# EasyEDA Pro project remote-a-v101.eprj, board main-board (continued)
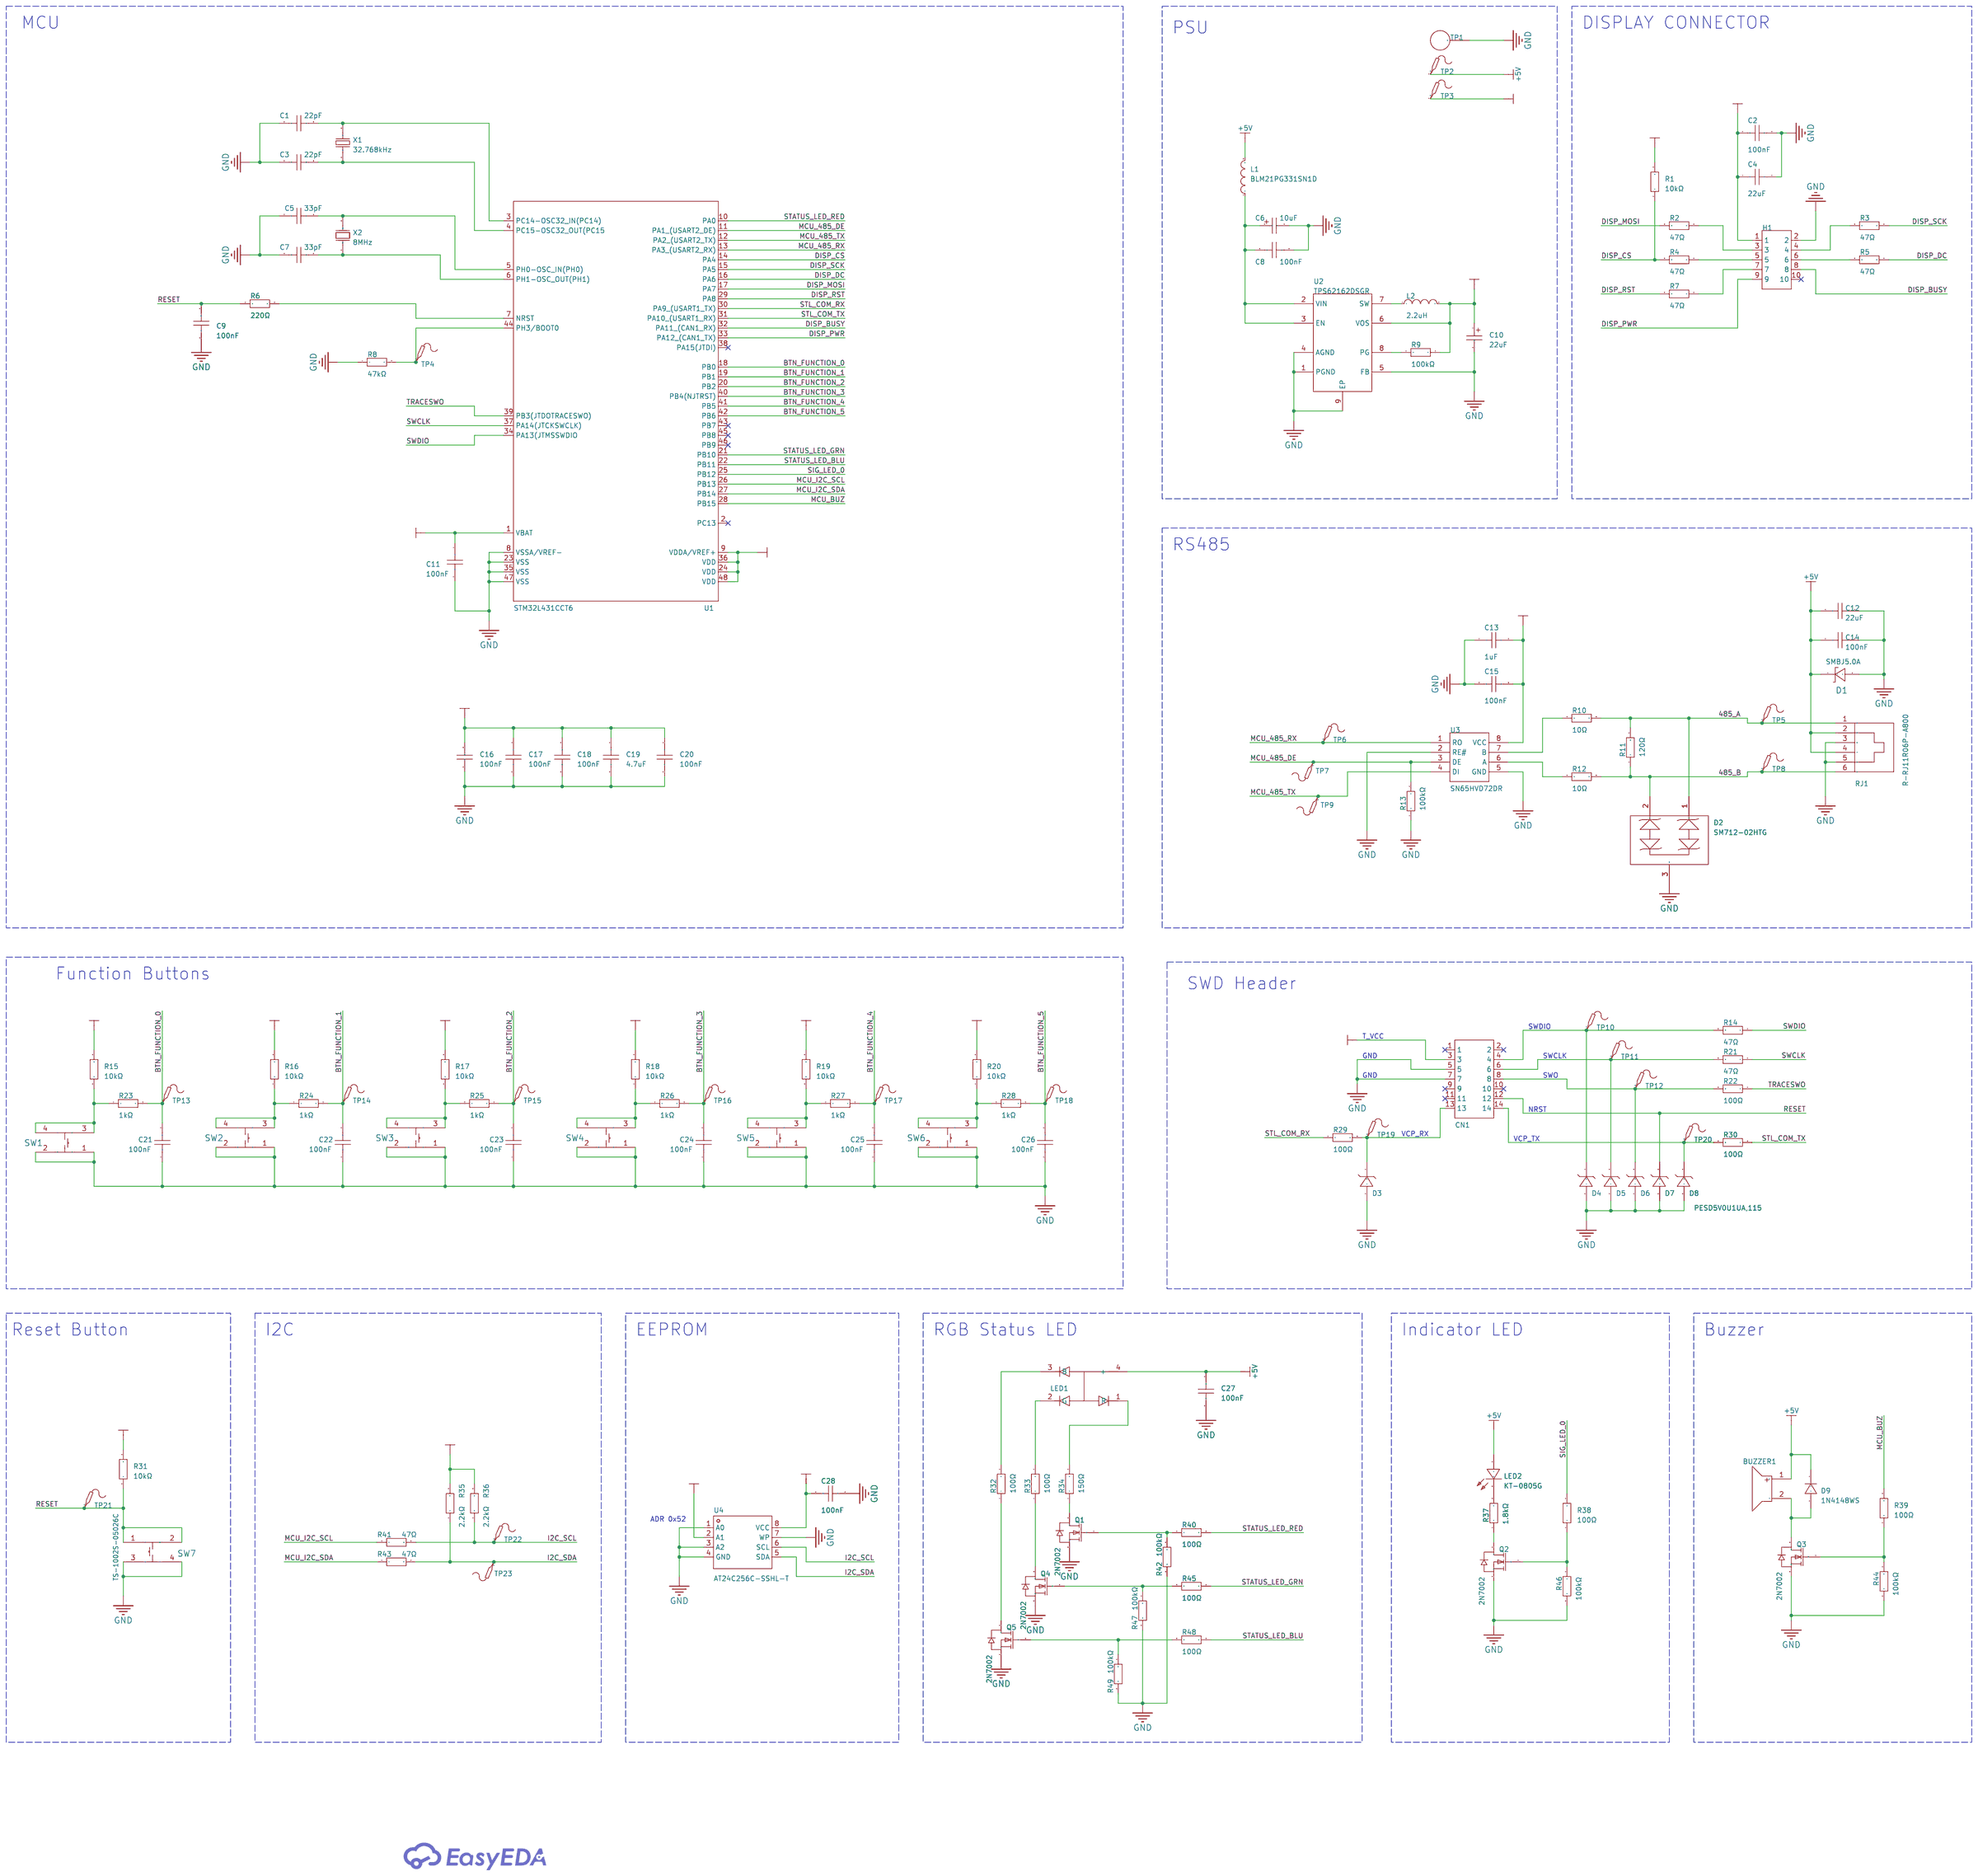
[diagram p0: schematic sheet]
## Footprints (pads in the part's own frame, mm; a bottom-side part is the same pattern mirrored in y, then rotated)
BUZ-TH_BD12.0-P6.50-D0.8
  round 1.8 hole 1.2: 1(-3.3,0) 2(3.3,0)
C0603
  rect 0.8x0.9 smd: 1(-0.7,0) 2(0.7,0)
C0805
  rect 1.41x1.35 smd: 1(-1,0) 2(1,0)
C1206
  rect 1.485x1.728 smd: 1(-1.593,0) 2(1.593,0)
CRYSTAL-SMD_L5.0-W3.2
  rect 1.9x2.4 smd: 1(-2.05,0) 2(2.05,0)
FC-135R_L3.2-W1.5
  rect 1x1.8 smd: 1(-1.25,0) 2(1.25,0)
HDR-TH_10P-P2.54-V-M-R2-C5-S2.54
  rect 1.7x1.7 hole 1.1: 1(-5.08,-1.27)
  round 1.7 hole 1.1: 2(-5.08,1.27) 3(-2.54,-1.27) 4(-2.54,1.27) 5(0,-1.27) 6(0,1.27) 7(2.54,-1.27) 8(2.54,1.27) 9(5.08,-1.27) 10(5.08,1.27)
HDR-TH_14P-P1.27-V-M-R2-C7-S1.27-2
  rect 1x1 hole 0.7: 1(-3.81,-0.635)
  round 1 hole 0.7: 2(-3.81,0.635) 3(-2.54,-0.635) 4(-2.54,0.635) 5(-1.27,-0.635) 6(-1.27,0.635) 7(0,-0.635) 8(0,0.635) 9(1.27,-0.635) 10(1.27,0.635) 11(2.54,-0.635) 12(2.54,0.635) 13(3.81,-0.635) 14(3.81,0.635)
IND-SMD_L2.0-W1.6-1
  rect 1.133x1.6 smd: 1(-0.967,0) 2(0.967,0)
KEY-SMD_4P-L6.0-W6.0-P4.50-LS9.0
  rect 1.9x1.3 smd: 1(-4.2,2.25) 2(4.2,2.25) 3(-4.2,-2.25) 4(4.2,-2.25)
L0805
  rect 1.133x1.377 smd: 1(-0.966,0) 2(0.966,0)
LED0805-R-RD
  rect 1x1.399 smd: 1(1.05,0) 2(-1.05,0)
LED-SMD_4P-L1.6-W1.5-TR-1
  rect 0.65x0.65 smd: 1(0.425,0.625) 2(0.425,-0.625) 3(-0.425,-0.625) 4(-0.425,0.625)
LQFP-48_L7.0-W7.0-P0.50-LS9.0-BL
  oval 0.27x1.5 smd: 1(-2.75,-4.25) 2(-2.25,-4.25) 3(-1.75,-4.25) 4(-1.25,-4.25) 5(-0.75,-4.25) 6(-0.25,-4.25) 7(0.25,-4.25) 8(0.75,-4.25) 9(1.25,-4.25) 10(1.75,-4.25) 11(2.25,-4.25) 12(2.75,-4.25) 25(2.75,4.25) 26(2.25,4.25) 27(1.75,4.25) 28(1.25,4.25) 29(0.75,4.25) 30(0.25,4.25) 31(-0.25,4.25) 32(-0.75,4.25) 33(-1.25,4.25) 34(-1.75,4.25) 35(-2.25,4.25) 36(-2.75,4.25)
  oval 1.5x0.27 smd: 13(4.25,-2.75) 14(4.25,-2.25) 15(4.25,-1.75) 16(4.25,-1.25) 17(4.25,-0.75) 18(4.25,-0.25) 19(4.25,0.25) 20(4.25,0.75) 21(4.25,1.25) 22(4.25,1.75) 23(4.25,2.25) 24(4.25,2.75) 37(-4.25,2.75) 38(-4.25,2.25) 39(-4.25,1.75) 40(-4.25,1.25) 41(-4.25,0.75) 42(-4.25,0.25) 43(-4.25,-0.25) 44(-4.25,-0.75) 45(-4.25,-1.25) 46(-4.25,-1.75) 47(-4.25,-2.25) 48(-4.25,-2.75)
Pad_e96
  round 1.3 hole 1.152: 1(0,0)
Pad_e110
  round 1.3 hole 1.152: 1(0,0)
Pad_e111
  round 1.3 hole 1.152: 1(0,0)
Pad_e112
  round 1.3 hole 1.152: 1(0,0)
R0603
  rect 0.806x0.864 smd: 1(-0.753,0) 2(0.753,0)
R1206
  rect 1.208x1.701 smd: 1(-1.479,0) 2(1.479,0)
RJ11-TH_PCB-6P6C-90
  rect 1.6x1.6 hole 1: 1(2.55,1.27)
  round 1.6 hole 1: 2(1.53,-1.27) 3(0.51,1.27) 4(-0.51,-1.27) 5(-1.53,1.27) 6(-2.55,-1.27)
SMB_L4.6-W3.6-LS5.3-RD
  rect 2.047x2.192 smd: 1(-2.361,0) 2(2.361,0)
SOD-323_L1.8-W1.3-LS2.5-RD
  rect 1x0.75 smd: 1(-1.173,0) 2(1.173,0)
SOIC-8_L4.9-W3.9-P1.27-LS6.0-BL
  oval 0.588x2.045 smd: 1(-1.905,-2.772) 2(-0.635,-2.772) 3(0.635,-2.772) 4(1.905,-2.772) 5(1.905,2.772) 6(0.635,2.772) 7(-0.635,2.772) 8(-1.905,2.772)
SOIC-8_L5.0-W4.0-P1.27-LS6.0-BL
  oval 0.569x1.95 smd: 1(-1.905,-2.705) 2(-0.635,-2.705) 3(0.635,-2.705) 4(1.905,-2.705) 5(1.905,2.705) 6(0.635,2.705) 7(-0.635,2.705) 8(-1.905,2.705)
SOT-23-3_L2.9-W1.3-P1.90-LS2.4-BR
  rect 1.25x0.7 smd: 1(1,-0.95) 2(1,0.95) 3(-1,0)
SOT-23_L2.9-W1.3-P1.90-LS2.4-BR
  rect 1x0.8 smd: 1(1.15,-0.95) 2(1.15,0.95) 3(-1.15,0)
Test-Point-0.5mm
  round 1.2 smd: 1(0,0)
Test-Point-0.5mm#2
  round 1.5 smd: 1(0,0)
TESTPOINT_TH_BD2.5-D1.2
  round 1.8 hole 1.2: 1(0,0)
WSON-8_L2.0-W2.0-P0.50-TL-EP
  rect 0.521x0.25 smd: 1(-0.95,0.75) 2(-0.95,0.25) 3(-0.95,-0.25) 4(-0.95,-0.75) 5(0.95,-0.75) 6(0.95,-0.25) 7(0.95,0.25) 8(0.95,0.75)
  rect 0.9x1.6 smd: 9(0,0)

## Nets
As in the schematic.

Pads without a net: CN1 1 2 9 10 11; H1 10; NOREF 1; NOREF#2 1; NOREF#3 1; NOREF#4 1; U1 2 38 43 45 46

## Via types
v1: diameter 0.61, hole 0.305, Top Layer to Bottom Layer, 464 vias

## Routing (per net, layer and track width the routed paths; a pad name or vN(x,y) marks a point on that pad's centre or on a via; arc(x,y) is an arc through that point)
+3V3: length 394.4
  Top Layer w0.457: 65.03,47.87 65.03,47.88 v1(66.31,49.15) ; v1(62.69,49.22) 62.69,48.05 62.73,48.01
  Top Layer w0.5: 69.47,35.83 65.39,35.83 62.1,39.12 59.06,39.12
  Top Layer w0.508: v1(66.93,39.56) 69.47,39.56 ; 59.06,39.12 58.42,39.12 57.91,38.61 v1(57.23,38.61)
  Top Layer w0.61: v1(56.26,47.24) 57.07,48.06 58.75,48.06 58.8,48.01
  Top Layer w1.016: 77.47,10.92 77.47,17.15 69.47,25.15 69.47,41.66 65.79,45.34 65.79,47.12 64.9,48.01 58.8,48.01
  Bottom Layer w0.203: 75.13,8.31 75.13,5.79 75.59,5.33 78.23,5.33 79.48,6.58 79.8,6.58 U2.6
  Bottom Layer w0.254: C13.2 C15.2 ; 55.77,46.56 55.77,46.76 v1(56.26,47.24) ; 55.77,46.56 C18.1 ; 55.77,46.56 U1.48 ; U1.24 65.91,41 C16.2 ; U3.8 30.16,6.41 29.84,6.1 29.84,5.08 ; TP3.1 73.79,8.9 ; U1.36 58.84,38.65 58.67,38.48 57.28,38.48 57.22,38.42 ; C19.1 57.22,37.85 57.22,38.42 ; v1(57.23,38.61) 57.23,38.59 57.22,38.58 ; 57.22,38.58 57.22,39.62 ; 57.22,38.58 57.22,38.42 ; C11.1 56.9,48.06 v1(57.85,48.06) U1.1 ; v1(62.69,49.22) 62.84,49.07 U1.9
  Bottom Layer w0.457: C20.1 65.85,48.69 v1(66.31,49.15) 68.46,49.15 71.25,51.93 71.25,52.58 72.14,53.47 73.66,53.47 74.03,53.09 R1.2
  Bottom Layer w0.508: 34.29,14.6 34.29,3.81 33.78,3.3 30.35,3.3 29.84,3.81 29.84,5.08 ; 34.29,14.6 46.86,14.6 48,15.74 R18.2 49.92,15.75 51.69,15.75 52.96,14.48 60.32,14.48 64.26,10.54 73.91,10.54 ; 34.29,14.6 32.28,14.6 31.28,15.61 R17.2 ; 116.71,35.18 R16.2 ; U4.8 103.75,22.09 104.14,22.48 104.14,23.8 C28.2 ; R15.2 116.94,64.9 116.97,64.87 ; R20.2 89.15,15.61 88.77,15.24 88.77,12.45 ; 110.11,12.28 110.11,20.82 ; 110.11,20.82 110.1,20.82 U4.2 ; 110.11,20.82 110.11,24 108.97,25.15 104.65,25.15 104.21,24.71 C28.2 ; 104.2,23.88 C28.2 ; C16.2 v1(66.93,39.56) ; C4.1 114.54,54.99 H1.1 ; 104.74,15.12 104.78,15.08 104.78,12.32 ; 104.74,15.12 R35.2 ; 104.74,15.12 R36.2 ; 74.17,10.92 74.17,13.59 72.14,15.61 R19.2
  Bottom Layer w0.559: C2.1 116.84,57.66 ; R31.2 90.42,82.42 ; 116.97,54.79 116.91,54.85 C4.1
  Bottom Layer w0.864: 57.46,81.82 CN1.3
  Bottom Layer w1.016: 88.94,12.45 114.68,12.45 116.97,14.73 116.97,71.25 105.66,82.55 58.19,82.55 57.51,81.86 ; C10.1 79.19,11.5 80.14,12.45 88.77,12.45
  vias: v1(74.93,10.81) v1(74.93,9.91) v1(75.31,9.02) v1(75.95,10.79) v1(75.95,9.91) v1(76.96,10.85) v1(76.96,9.91) v1(77.98,10.79) v1(77.98,9.91) v1(77.98,8.89)
+5V: length 184.9
  Top Layer w0.254: LED1.4 4.52,70.68 v1(3.71,70.68)
  Top Layer w0.508: v1(3.71,70.68) 3.68,70.65 v1(3.68,61.09) 4.96,61.09 LED2.1
  Bottom Layer w0.254: TP2.1 88.42,4.09 86.87,2.54 84.89,2.54 L1.2 ; C27.1 v1(3.71,70.68)
  Bottom Layer w0.508: v1(3.68,61.09) 3.17,61.09 2.03,59.94 2.03,32.11 BUZZER1.1
  Bottom Layer w0.61: C12.2 49.09,8.81 C14.1 ; BUZZER1.1 9.09,25.05 D9.1
  Bottom Layer w1.016: 59.47,6.25 RJ1.2 52.74,6.25 51.56,5.08 49.73,5.08 D1.1 49.6,8.29 C12.2 ; 59.47,6.25 RJ1.4 ; 59.47,6.25 59.56,6.17 59.56,1.78 ; 59.56,1.78 81.58,1.78 L1.2 ; 59.56,1.78 18.03,1.78 6.6,13.21 6.6,24.35 BUZZER1.1
GND: length 79.5
  Top Layer w0.254: 65.73,16.67 65.79,16.61 v1(65.79,15.62) ; v1(113.74,30.78) 113.76,30.8 SW2.2 ; v1(113.72,39.22) 114.73,39.22 SW2.1 ; SW6.1 85.85,16.68 v1(85.85,15.62) ; v1(34.16,15.62) 34.2,15.66 SW3.2 ; v1(94.23,15.62) 94.23,16.69 SW6.2 ; v1(45.85,15.62) 45.85,16.68 SW4.1 ; v1(25.78,15.62) 25.8,15.64 SW3.1 ; SW1.1 115.81,69.2 v1(115.82,69.22) ; SW4.2 54.2,15.65 v1(54.23,15.62) ; SW1.2 115.79,60.8 v1(115.82,60.83) ; v1(74.17,15.62) 74.2,15.65 SW5.2
  Bottom Layer w0.254: R42.2 17.19,72.78 v1(17.21,72.76) ; v1(64.9,56.56) 64.9,56.07 C7.1 ; v1(46.23,8.86) 47.04,8.86 C12.1 47.01,8.13 v1(46.23,8.13) ; C14.2 v1(46.9,10.67) ; v1(68.07,48.13) 67.38,48.13 C20.2 ; v1(55.8,38.79) 55.81,38.8 C17.2 v1(55,39.62) ; C22.1 77.94,42.29 ; v1(55.45,48.95) 55.43,48.93 C11.2 v1(54.62,48.13) ; U4.3 109.07,19.55 v1(109.09,19.53) ; U1.35 59.34,40.59 v1(59.65,40.89) ; v1(106.43,23.88) 106.42,23.87 C28.1 ; v1(100.58,20.83) 100.59,20.82 U4.7 ; 93.82,73.43 93.82,72.39 v1(93.83,72.39) ; R13.1 v1(15.4,9.14) ; v1(55.26,75.01) 55.25,75 D4.2 ; v1(44.83,3.68) 44.88,3.74 D1.2 ; v1(54.87,37.72) C19.2 55.69,36.89 v1(55.68,36.88) ; Q3.2 18.16,19.23 v1(18.16,18.54) ; v1(66.7,38.16) C16.1 65.91,37.72 v1(66.29,37.34) ; Q2.2 3.19,51.2 v1(3.17,51.18) ; v1(44.83,6.73) 44.88,6.68 D1.2 ; D6.2 59.06,75 v1(59.07,75.01) ; D5.2 57.15,75 v1(57.17,75.01) ; C2.2 111.16,57.63 v1(110.36,57.63) ; v1(17.21,69.33) 17.19,69.35 R47.2 ; v1(14.58,69.93) 14.58,69.16 Q4.2 ; v1(109.09,22.1) 109.09,22.09 U4.1 ; v1(54.15,47.14) 54.16,47.13 C18.2 v1(53.4,46.36) ; v1(14.58,73.36) 14.58,72.59 Q1.2 ; D3.2 64.77,75 v1(64.79,75.01) ; v1(109.09,18.29) 109.09,18.28 U4.4 ; D1.2 v1(46.34,5.21) ; D1.2 v1(43.4,5.21) ; U1.23 64.82,41.56 v1(64.52,41.87) ; v1(58.67,45.76) 58.37,46.06 U1.47 ; R44.2 18.77,24.5 v1(18.8,24.48) ; v1(67.83,57.96) 67.82,57.95 C9.1 ; D2.3 43.39,8.58 v1(43.4,8.57) ; Q5.2 14.58,65.73 v1(14.58,66.5) ; C23.1 77.94,40.51 ; C13.1 32.07,4.26 v1(32.06,4.24) ; v1(28.7,10.79) 28.74,10.76 U3.5 ; C3.1 58.8,55.79 v1(58.82,55.8) ; C1.1 57.02,55.79 v1(57.04,55.8) ; R49.2 17.19,65.92 v1(17.21,65.91) ; v1(62.57,46.74) 62.36,46.95 62.36,48.05 U1.8 ; v1(62.31,56.5) 62.29,56.48 C5.1 ; v1(62.88,75.01) 62.87,75 D8.2 ; 85.4,73.38 85.4,72.36 ; R46.2 v1(3.36,49.4) ; v1(115.82,52.83) 115.81,52.85 C4.2 ; D7.2 60.96,75 v1(60.98,75.01) ; v1(26.16,8.23) 26.15,8.22 U3.2 ; R8.1 v1(47.86,47.5) ; 27.37,5.08 27.37,4.25 v1(27.36,4.24) ; C21.1 77.94,44.07 ; C27.2 2.54,68.44 ; C26.1 v1(44.7,45.72) ; C25.1 v1(44.7,43.94) ; C24.1 v1(44.7,42.16)
  vias: v1(2.54,68.44) v1(5.44,76.56) v1(5.44,66.4) v1(5.44,30.84) v1(5.44,25.76) v1(5.44,20.68) v1(5.44,15.6) v1(5.44,10.52) v1(10.52,81.64) v1(10.52,76.56) v1(10.52,66.4) v1(10.52,30.84) v1(10.52,20.68) v1(10.52,15.6) v1(10.52,5.44) v1(15.6,81.64) v1(15.6,76.56) v1(15.6,66.4) v1(15.6,61.32) v1(15.6,56.24) v1(15.6,51.16) v1(15.6,46.08) v1(15.6,41) v1(15.6,35.92) v1(15.6,30.84) v1(15.6,15.6) v1(15.6,10.52) v1(20.55,72.49) v1(20.57,69.09) v1(20.68,81.64) v1(20.68,76.56) v1(20.68,61.32) v1(20.68,56.24) v1(20.68,51.16) v1(20.68,46.08) v1(20.68,41) v1(20.68,35.92) v1(20.68,5.44) v1(25.76,81.64) v1(25.76,76.56) v1(25.76,71.48) v1(25.76,65.89) v1(25.76,61.32) v1(25.76,56.24) v1(25.76,51.16) v1(25.76,46.08) v1(25.76,41) v1(25.76,35.92) v1(25.76,30.84) v1(25.76,25.76) v1(25.76,20.68) v1(25.76,5.44) v1(30.84,81.64) v1(30.84,76.56) v1(30.84,71.48) v1(30.84,61.32) v1(30.84,56.24) v1(30.84,51.16) v1(30.84,46.08) v1(30.84,41) v1(30.84,35.92) v1(30.84,30.84) v1(30.84,25.76) v1(30.84,20.68) v1(35.92,81.64) v1(35.92,76.56) v1(35.92,71.48) v1(35.92,61.32) v1(35.92,56.24) v1(35.92,51.16) v1(35.92,46.08) v1(35.92,41) v1(35.92,35.92) v1(35.92,30.84) v1(35.94,25.53) v1(35.94,20.7) v1(35.92,5.44) v1(40.26,46.61) v1(40.39,61.34) v1(40.39,57.02) v1(40.39,40.26) v1(41,81.64) v1(41,76.56) v1(41,35.92) v1(41,30.84) v1(41.02,25.53) v1(41,20.68) v1(41,15.6) v1(41,10.52) v1(41,5.44) v1(42.67,61.34) v1(42.67,57.15) v1(42.67,49.15) v1(46.08,81.64) v1(46.08,76.56) v1(46.08,61.32) v1(46.1,56.77) v1(46.08,51.16) v1(46.08,10.52) v1(46.99,24) v1(47.07,30.84) v1(47.24,35.94) v1(49.78,24) v1(49.91,35.94) v1(49.91,30.86) v1(51.05,44.7) v1(51.16,81.64) v1(51.16,76.56) v1(51.16,61.32) v1(51.16,56.24) v1(51.16,51.16) v1(51.31,46.48) v1(51.31,43.05) v1(52.45,41.28) v1(53.72,35.94) v1(53.7,30.96) v1(53.7,23.99) v1(56.01,8.13) v1(56.24,76.56) v1(56.24,61.32) v1(56.24,56.24) v1(56.24,30.84) v1(56.24,20.68) v1(56.24,15.6) v1(56.24,10.52) v1(57.41,78.33) v1(57.66,5.08) v1(58.29,4.83) v1(58.67,46.74) v1(58.67,44.79) v1(58.67,43.81) v1(58.67,42.84) v1(58.67,41.87) v1(58.67,40.89) v1(59,9.95) v1(59.13,36.37) v1(59.31,78.49) v1(59.65,46.74) v1(60,9.95) v1(60.05,43.84) v1(60.63,78.49) v1(60.62,46.74) v1(60.62,40.89) v1(60.83,4.83) v1(61.09,9.91) v1(61.32,71.48) v1(61.32,61.32) v1(61.32,10.52) v1(61.47,5.08) v1(61.59,46.74) v1(61.59,45.38) v1(61.59,43.84) v1(61.59,42.3) v1(61.59,40.89) v1(61.98,9.91) v1(62.57,40.89) v1(62.99,78.36) v1(63.14,43.84) v1(63.54,46.74) v1(63.54,40.89) v1(63.88,6.6) v1(64.52,78.61) v1(64.52,46.74) v1(64.52,45.76) v1(64.52,44.79) v1(64.52,43.81) v1(64.52,42.84) v1(64.52,40.89) v1(64.64,35.43) v1(66.4,76.56) v1(71.48,76.56) v1(71.48,71.48) v1(71.48,46.08) v1(71.48,25.76) v1(71.48,5.44) v1(76.56,76.56) v1(76.56,71.48) v1(76.56,66.4) v1(76.56,61.32) v1(76.56,56.24) v1(76.56,30.84) v1(76.56,20.68) v1(77.09,50.04) v1(77.09,48.26) v1(77.09,46.59) v1(77.95,44.07) v1(77.95,42.29) v1(77.95,40.51) v1(79.81,5.63) v1(79.8,4.93) v1(80.14,56.26) v1(80.77,5.63) v1(80.77,4.93) v1(81.64,25.76) v1(81.64,20.68) v1(81.64,15.6) v1(81.73,5.63) v1(81.74,4.93) v1(82.04,8.89) v1(82.42,56.26) v1(82.55,8.13) v1(83.49,10.87) v1(83.49,10.01) v1(83.49,9.13) v1(84.33,8.13) v1(84.71,56.26) v1(84.71,43.05) v1(84.84,38.48) v1(85.09,9.65) v1(85.4,72.4) v1(85.85,9.65) v1(85.98,10.79) v1(86.72,76.56) v1(86.72,71.48) v1(86.72,66.4) v1(86.72,30.84) v1(86.72,25.76) v1(86.72,20.68) v1(91.8,76.56) v1(91.8,71.48) v1(91.8,66.4) v1(91.8,61.32) v1(91.8,56.24) v1(91.82,52.58) v1(91.8,43.03) v1(91.82,38.48) v1(91.8,30.84) v1(91.8,25.76) v1(91.8,20.68) v1(91.8,15.6) v1(91.8,10.52) v1(91.8,5.44) v1(96.88,76.56) v1(96.88,71.48) v1(96.88,66.4) v1(96.88,61.32) v1(96.88,56.24) v1(96.9,52.58) v1(96.9,43.05) v1(96.88,25.76) v1(96.88,20.68) v1(96.88,15.6) v1(96.88,10.52) v1(96.88,5.44) v1(100.58,19.02) v1(100.58,17.56) v1(101.96,76.56) v1(101.96,71.48) v1(101.96,66.4) v1(101.96,61.32) v1(101.96,56.24) v1(101.98,52.58) v1(101.98,43.05) v1(101.98,38.32) v1(101.96,30.84) v1(101.96,25.76) v1(101.96,15.6) v1(101.96,10.52) v1(101.96,5.44) v1(103.89,49.78) v1(107.04,76.56) v1(107.04,71.48) v1(107.04,66.4) v1(107.04,61.32) v1(107.04,56.24) v1(107.04,35.92) v1(107.04,30.84) v1(107.04,15.6) v1(107.04,10.52) v1(107.04,5.44) v1(107.06,42.67) v1(107.82,47.75) v1(107.87,49.33) v1(108.08,53.21) v1(108.61,46.15) v1(110.62,49.34) v1(110.87,46.37) v1(111.51,43.43) v1(112.12,81.64) v1(112.12,71.48) v1(112.12,66.4) v1(112.12,61.32) v1(112.12,41) v1(112.12,30.84) v1(112.12,25.76) v1(112.12,20.68) v1(112.12,15.6) v1(112.12,10.52) v1(112.12,5.44) v1(113.28,52.07) v1(117.2,81.64) v1(117.2,76.56) v1(117.2,10.52) v1(117.2,5.44)
485_A: length 29
  Bottom Layer w0.254: 38.09,7.1 35.97,7.1 35.76,7.31 ; 38.09,7.1 38.09,4.45 TP5.1 ; 38.09,7.1 39.11,7.1 39.62,7.62 40.23,7.62 D2.1 44.21,7.63 44.83,8.25 44.83,10.41 46.35,11.94 50.55,11.94 53.69,8.79 RJ1.1
485_B: length 36.6
  Bottom Layer w0.254: R11.1 38.09,12.13 TP8.1 ; R11.1 39.09,10.06 39.5,9.65 40.12,9.65 D2.2 41.41,9.53 44.7,12.83 60.32,12.83 63.5,9.65 63.5,7.21 RJ1.6 ; R11.1 35.84,10.06 35.76,9.98
BTN_FUNCTION_0: length 16.7
  Bottom Layer w0.254: TP13.1 80.81,44.91 76.59,44.91 C21.2 74.92,44.91 73.36,44.91 R23.2 65.85,44.07 U1.18
BTN_FUNCTION_1: length 17.4
  Bottom Layer w0.254: TP14.1 80.28,43.18 76.64,43.18 C22.2 74.87,43.18 73.41,43.18 R24.2 72.14,42.29 70.87,43.56 65.85,43.56 U1.19
BTN_FUNCTION_2: length 18.1
  Bottom Layer w0.254: TP15.1 79.91,41.4 76.64,41.4 C23.2 74.87,41.4 73.41,41.4 R25.2 72.01,40.51 69.47,43.05 65.86,43.05 U1.20
BTN_FUNCTION_3: length 17.7
  Bottom Layer w0.254: U1.40 52.6,42.56 52.2,42.16 R26.2 49.27,41.28 47.37,41.28 46.93,41.72 C24.2 46.04,41.28 42.57,41.28 TP16.1
BTN_FUNCTION_4: length 17.8
  Bottom Layer w0.254: U1.41 52.31,43.06 51.44,43.94 R27.2 49.27,43.05 47.37,43.05 46.93,43.5 C25.2 46.06,43.08 42.53,43.08 TP17.1
BTN_FUNCTION_5: length 18.3
  Bottom Layer w0.254: TP18.1 42.38,44.91 46.12,44.91 C26.2 46.93,45.27 47.37,44.83 49.27,44.83 R28.2 50.28,45.59 51.05,45.59 53.08,43.56 U1.42
DISP_BUSY: length 75.6
  Top Layer w0.254: v1(60.2,36.83) 59.82,36.45 v1(59.82,23.75) ; v1(93.85,32.39) 108.71,47.24 109.22,47.24 109.35,47.37
  Bottom Layer w0.254: v1(60.2,36.83) 60.84,37.48 U1.32 ; v1(59.82,23.75) 70.36,23.75 78.99,32.39 v1(93.85,32.39)
DISP_CS: length 10.2
  Bottom Layer w0.254: U1.14 67.02,46.06 71.63,50.67 R4.2 R1.1
DISP_DC: length 7.6
  Bottom Layer w0.254: R5.1 71.75,47.37 69.44,45.06 65.85,45.06 U1.16
DISP_MOSI: length 7.2
  Bottom Layer w0.254: R2.2 72.01,45.72 70.85,44.56 U1.17
DISP_PWR: length 81.8
  Top Layer w0.254: v1(58.22,21.95) 58.22,36.37 59.69,37.85 v1(59.94,37.85) ; v1(96.77,29.72) H1.9
  Bottom Layer w0.254: U1.33 60.34,38.25 v1(59.94,37.85) ; v1(58.22,21.95) 72.87,21.95 80.65,29.72 v1(96.77,29.72)
DISP_RST: length 5.8
  Bottom Layer w0.254: U1.29 62.34,36.05 R7.2
DISP_SCK: length 8.1
  Bottom Layer w0.254: U1.15 68.17,45.56 71.63,49.02 R3.1
I2C_SCL: length 58.8
  Top Layer w0.254: v1(65.63,19.91) 65.63,32.11 v1(65.66,32.13)
  Bottom Layer w0.254: TP22.1 65.64,32.88 R41.2 v1(65.66,32.13) ; R36.1 105.67,17.77 103.89,19.56 102.01,19.56 U4.6 101.1,19.55 100.84,19.81 65.74,19.81 v1(65.63,19.91)
I2C_SDA: length 58.5
  Top Layer w0.254: v1(64.01,18.8) v1(64.01,32.13)
  Bottom Layer w0.254: R43.2 63.99,32.88 63.99,32.11 ; v1(64.01,32.13) 63.99,32.11 ; 63.99,32.11 TP23.1 ; R35.1 103.89,17.65 103.25,18.29 102.01,18.29 U4.5 77.67,18.28 77.15,18.8 v1(64.01,18.8)
MCU_485_DE: length 90.6
  Top Layer w0.254: v1(20.95,10.41) v1(20.95,29.72) ; v1(60.83,57.66) 60.83,52.7 v1(64.13,49.4)
  Bottom Layer w0.254: U3.3 22.75,9.49 TP7.1 ; U1.11 63.84,49.11 v1(64.13,49.4) ; R13.2 18.22,9.08 TP7.1 ; v1(60.83,57.66) 48.9,57.66 v1(20.95,29.72) ; v1(20.95,10.41) 21.08,10.41 22.34,9.15 TP7.1
MCU_485_RX: length 85.3
  Top Layer w0.254: v1(27.81,14.22) 27.69,14.35 v1(27.69,19.81) ; v1(66.93,46.99) 71.5,42.42 v1(71.5,30.73)
  Bottom Layer w0.254: v1(27.69,19.81) 34.67,26.8 67.58,26.8 71.5,30.72 v1(71.5,30.73) ; v1(66.93,46.99) 66.5,46.56 U1.13 ; TP6.1 22.79,6.95 U3.1 26.16,6.95 27.81,8.6 v1(27.81,14.22)
MCU_485_TX: length 90.6
  Top Layer w0.254: v1(24.39,37.18) 24.39,11.93 v1(24.01,11.55) ; v1(65.15,49.4) 65.15,49.78 64.13,50.8 v1(64.13,59.44)
  Bottom Layer w0.254: v1(64.13,59.44) 46.64,59.44 v1(24.39,37.18) ; U3.4 24.3,10.76 ; 24.3,10.76 24.01,11.05 v1(24.01,11.55) ; 24.3,10.76 23.36,10.76 TP9.1 ; v1(65.15,49.4) 64.34,48.6 U1.12
MCU_BUZ: length 5.4
  Bottom Layer w0.254: U1.28 62.84,35.41 62.36,34.92 R39.2
MCU_I2C_SCL: length 5.9
  Bottom Layer w0.254: R41.1 65.66,35.94 63.84,37.75 U1.26
MCU_I2C_SDA: length 5.4
  Bottom Layer w0.254: R43.1 64.01,36.58 63.37,37.21 63.37,39.54 U1.27
RESET: length 85.6
  Top Layer w0.254: v1(69.34,77.94) v1(69.34,55.75) ; v1(66.93,55.75) 66.93,70.23 64.39,72.77 v1(61.85,72.77)
  Bottom Layer w0.254: 66.9,55.91 66.8,56.01 66.8,58.83 TP21.1 ; v1(61.85,72.77) 61.85,75.59 D7.1 60.96,77.47 62.54,79.05 CN1.12 ; 88.91,77.94 88.91,77.95 R31.1 ; 88.91,77.94 SW7.2 v1(69.34,77.94) ; 88.91,77.94 SW7.1 ; C9.2 67.75,55.75 v1(66.93,55.75) ; C9.2 67.88,55.75 v1(69.34,55.75) ; C9.2 R6.1
SIG_LED_0: length 6.4
  Bottom Layer w0.254: U1.25 64.34,38.27 67.31,35.31 R38.2
STATUS_LED_BLU: length 8.7
  Bottom Layer w0.254: U1.22 66.77,42.06 71.63,37.21 R48.1
STATUS_LED_GRN: length 8.2
  Bottom Layer w0.254: R45.1 71.88,38.86 68.2,42.55 65.87,42.55 U1.21
STATUS_LED_RED: length 9
  Bottom Layer w0.254: U1.10 63.34,49.63 63.88,50.17 67.69,50.17 69.47,51.94 R40.2
STL_COM_RX: length 6.8
  Bottom Layer w0.254: U1.30 61.84,36.45 60.64,35.24 59.89,35.24 R29.1
STL_COM_TX: length 7.7
  Bottom Layer w0.254: R30.1 57.65,34.41 58.93,35.69 60.2,35.69 61.34,36.83 U1.31
SWCLK: length 8.3
  Bottom Layer w0.254: R21.1 52.79,38.61 55.25,41.06 U1.37
SWDIO: length 6.9
  Bottom Layer w0.254: U1.34 59.84,38.76 55.75,34.67 R14.1
TRACESWO: length 8
  Bottom Layer w0.254: U1.39 57.32,42.04 54.48,42.04 52.71,40.26 50.13,40.26 R22.1
$1N4329: length 7.9
  Bottom Layer w0.254: U1.5 60.84,52.1 61.32,52.58 60.9,53.01 C5.2
$1N4330: length 10.1
  Bottom Layer w0.254: U1.6 61.34,49.66 64.13,52.45 65.3,52.45 X2.1 65.85,53.01 C7.2
$1N5436: length 58.7
  Top Layer w0.254: v1(43.69,68.07) v1(43.69,40.39)
  Bottom Layer w0.254: R22.2 48.5,40.39 v1(43.69,40.39) ; v1(43.69,68.07) 56.17,68.07 TP12.1 59.94,71.84 59.94,75.59 D6.1 59.06,77.22 60,78.16 CN1.8
$1N5439: length 108.3
  Top Layer w0.254: v1(81.28,75.95) 81.41,75.82 v1(81.41,31.11) ; v1(59.06,22.86) v1(59.06,32.13)
  Bottom Layer w0.254: v1(81.28,75.95) 65.91,75.95 65.79,75.82 ; v1(81.41,31.11) 79.76,31.11 71.5,22.86 v1(59.06,22.86) ; 65.79,75.82 65.79,71.82 TP19.1 ; 65.79,75.82 65.12,76.48 D3.1 64.77,77.34 65.28,77.85 65.28,79.76 64.4,80.64 CN1.13 ; v1(59.06,32.13) R29.2
$1N5442: length 64.1
  Top Layer w0.254: v1(41.53,69.47) v1(41.53,38.61)
  Bottom Layer w0.254: v1(41.53,69.47) 56.01,69.47 57.03,70.49 TP11.1 58.04,71.95 58.04,75.59 D5.1 57.15,77.15 58.73,78.73 CN1.6 ; v1(41.53,38.61) R21.2
$1N5443: length 80.5
  Top Layer w0.254: v1(39.24,70.95) v1(39.24,33.02)
  Bottom Layer w0.254: v1(39.24,70.95) TP10.1 56.13,71.95 56.13,75.59 D4.1 55.25,77.09 57.46,79.3 CN1.4 ; R14.2 55.63,33.02 v1(39.24,33.02)
$1N5454: length 112.7
  Top Layer w0.254: v1(78.74,25.27) 78.74,77.47 76.84,79.38 63.82,79.38 CN1.14 ; v1(57.4,20.96) v1(57.4,32.13)
  Bottom Layer w0.254: CN1.14 63.81,78.03 62.87,77.09 D8.1 63.75,75.59 63.75,71.88 62.88,71.01 TP20.1 ; v1(78.74,25.27) 74.42,20.96 v1(57.4,20.96) ; v1(57.4,32.13) R30.2
$1N6636: length 66.3
  Top Layer w0.254: v1(74.8,44.07) 75.44,44.7 v1(75.44,62.36) ; SW1.4 110.25,64.88 v1(110.24,64.9) ; SW1.3 110.25,64.9
  Bottom Layer w0.254: R15.1 v1(110.24,64.9) 109.35,64.9 106.81,62.36 v1(75.44,62.36) ; v1(74.8,44.07) R23.1
$1N6640: length 111.6
  Top Layer w0.254: v1(85.98,64.01) v1(85.98,37.21)
  Bottom Layer w0.254: v1(85.98,64.01) 23.5,64.01 20.07,67.43 R49.1 14.79,67.43 Q5.1 ; v1(85.98,37.21) R48.2
$1N6642: length 107.1
  Top Layer w0.254: v1(83.44,65.28) v1(83.44,38.86)
  Bottom Layer w0.254: v1(83.44,38.86) R45.2 ; Q4.1 16.19,71.05 R47.1 22.49,70.86 28.07,65.28 v1(83.44,65.28)
$1N6643: length 74.1
  Top Layer w0.254: v1(71.12,66.42) v1(71.12,53.85)
  Bottom Layer w0.254: R40.1 69.48,53.85 v1(71.12,53.85) ; Q1.1 14.79,74.29 R42.1 24.39,74.29 32.26,66.42 v1(71.12,66.42)
$1N6645: length 3.5
  Bottom Layer w0.254: Q5.3 11.18,66.67 10.02,67.83 R32.1
$1N6646: length 2.6
  Bottom Layer w0.254: Q4.3 R33.1
$1N6648: length 3.4
  Top Layer w0.254: v1(6.35,69.34) 5.46,69.34 LED1.2
  Bottom Layer w0.254: v1(6.35,69.34) 6.86,69.34 7.62,70.1 R33.2
$1N6649: length 4.8
  Top Layer w0.254: v1(4.57,68.58) 4.57,69.37 LED1.3
  Bottom Layer w0.254: R32.2 4.83,68.33 v1(4.57,68.58)
$1N6650: length 3.5
  Bottom Layer w0.254: R34.1 10.02,72.38 11.18,73.53 Q1.3
$1N26550: length 3
  Bottom Layer w0.254: U3.7 31.37,8.22 32.28,7.31 R10.1
$1N26601: length 2.8
  Bottom Layer w0.254: U3.6 31.33,9.49 31.82,9.98 R12.1
$1N35622: length 8.8
  Bottom Layer w0.254: U1.7 61.84,49.4 63.25,50.8 66.8,50.8 67.82,51.82 R6.2
$1N35628: length 18.4
  Bottom Layer w0.254: TP4.1 42.47,46.61 49.27,46.61 R8.2 51.82,47.5 52.32,46.99 52.32,45.85 53.61,44.56 U1.44
$1N53853: length 9.4
  Top Layer w0.254: v1(74.29,5.33) 76.71,5.33 v1(79.88,8.51)
  Bottom Layer w0.254: v1(79.88,8.51) 79.88,7.66 U2.8 ; v1(74.29,5.33) R9.1
$1N59740: length 7.5
  Bottom Layer w0.254: U1.3 59.84,48.99 58.8,50.04 57.78,50.04 56.66,51.16 X1.2 57.02,51.92 C1.2
$1N59741: length 6.1
  Bottom Layer w0.254: C3.2 58.8,51.92 X1.1 59.16,51.2 60.34,50.02 U1.4
$1N59998: length 53.1
  Top Layer w0.254: SW2.3 SW2.4 ; v1(76.71,35.18) 76.71,40.39 v1(74.8,42.29)
  Bottom Layer w0.254: R16.1 v1(110.24,35.18) v1(76.71,35.18) ; v1(74.8,42.29) R24.1
$1N60231: length 71.3
  Top Layer w0.254: SW3.3 SW3.4 36.45,14.48 v1(36.45,19.69) ; v1(74.8,32.26) v1(74.8,40.51)
  Bottom Layer w0.254: v1(74.8,40.51) R25.1 ; v1(36.45,19.69) 42.42,25.65 68.2,25.65 v1(74.8,32.26) ; R17.1 v1(29.84,12.19)
$1N60464: length 40.7
  Top Layer w0.254: SW4.4 48.62,12.23 ; 48.62,12.23 SW4.3 ; 48.62,12.23 v1(48.62,14.22) 48.62,41.42 v1(47.88,42.16)
  Bottom Layer w0.254: R18.1 49.9,14.22 v1(48.62,14.22) ; v1(47.88,42.16) R26.1
$1N60697: length 56.9
  Top Layer w0.254: v1(64.29,12.22) 64.3,12.23 SW5.3 SW5.4 ; v1(51.18,16.89) 51.18,42.04 49.28,43.94 v1(47.88,43.94)
  Bottom Layer w0.254: v1(47.88,43.94) R27.1 ; v1(51.18,16.89) 59.61,16.89 v1(64.29,12.22) ; R19.1 v1(69.98,12.19)
$1N60930: length 83.4
  Top Layer w0.254: v1(90.75,14.1) 90.75,12.27 90.71,12.23 ; v1(83.06,14.1) 83.06,13.21 84.07,12.19 85.76,12.19 SW6.3 90.71,12.23 ; 90.71,12.23 SW6.4 ; v1(47.88,45.72) 45.85,43.69 v1(45.85,17.91)
  Bottom Layer w0.254: v1(47.88,45.72) R28.1 ; v1(83.06,14.1) 79.5,14.1 75.69,17.91 v1(45.85,17.91) ; v1(90.75,14.1) 89.92,14.1 R20.1
$1N61445: length 86.5
  Top Layer w0.254: v1(67.31,27.81) v1(67.31,32.13)
  Bottom Layer w0.254: v1(67.31,32.13) R38.1 ; v1(67.31,27.81) 11.94,27.81 5.71,34.04 R46.1 5.9,49.6 Q2.1
$1N61447: length 1.7
  Bottom Layer w0.254: Q2.3 R37.1
$1N61578: length 36.7
  Top Layer w0.254: 109.35,52.45 105.03,52.45 v1(101.79,49.21)
  Bottom Layer w0.254: v1(101.79,49.21) 74.22,49.21 R3.2
$1N61623: length 45
  Bottom Layer w0.254: R2.1 103.76,45.72 106.68,48.64 113.03,48.64 113.66,49.28 113.66,50.67 H1.3
$1N61666: length 38.6
  Bottom Layer w0.254: R4.1 75.18,50.67 75.69,51.18 110.62,51.18 H1.5
$1N61711: length 69.9
  Top Layer w0.254: H1.7 110.62,48.64 104.39,48.64 v1(89.53,33.78) ; v1(60.71,24.64) v1(60.71,32.13)
  Bottom Layer w0.254: v1(60.71,32.13) R7.1 ; v1(60.71,24.64) 69.34,24.64 78.49,33.78 v1(89.53,33.78)
$1N61751: length 36.4
  Bottom Layer w0.254: 109.35,49.91 109.28,49.97 105.35,49.97 102.81,47.43 74.1,47.43 R5.2
$1N62202: length 1.8
  Bottom Layer w0.965: L1.1 85.55,5.59
$1N63206: length 4.1
  Top Layer w0.254: v1(5.46,71.5) 5.46,70.66 LED1.1
  Bottom Layer w0.254: R34.2 5.84,71.88 v1(5.46,71.5)
$1N63374: length 2.6
  Top Layer w0.254: LED2.2 4.95,58.9 v1(4.95,57.91)
  Bottom Layer w0.254: R37.2 v1(4.95,57.91)
$1N70754: length 61
  Top Layer w0.254: v1(62.36,32.13) v1(62.36,18.92)
  Bottom Layer w0.254: R39.1 v1(62.36,32.13) ; R44.1 18.14,22.88 Q3.1 20.38,21.14 22.6,18.92 v1(62.36,18.92)
$1N70759: length 10.9
  Bottom Layer w0.254: BUZZER1.2 8.23,19.3 13.08,19.3 13.97,20.19 Q3.3 16.26,20.3 D9.2

## Copper pours and planes (outline as drawn; the poured copper is in the pictures)
+3V3 on Top Layer: 73.53,11.3 80.14,11.3 80.14,8 73.53,8
+3V3 on Bottom Layer: 73.56,11.3 80.16,11.3 80.16,8 73.56,8
GND on Top Layer: -1.52,85.85 121.03,85.85 121.03,-1.14 -1.52,-1.14
GND on Bottom Layer: 79.48,6.11 82.32,6.11 82.32,4.57 79.48,4.57
GND on Bottom Layer: -2.54,87.5 121.79,87.5 121.79,-1.27 -2.54,-1.27
GND on Bottom Layer: 80.34,11.3 86.49,11.3 86.49,7.49 80.34,7.49
GND on Inner1: -2.92,86.23 122.43,86.23 122.43,-2.16 -2.92,-2.16
GND on Inner2: -4.44,87.63 123.95,87.63 123.95,-3.05 -4.44,-3.05
$1N53851 on Bottom Layer: 75.59,7.24 79.61,7.24 79.61,5.84 75.59,5.84
$1N62202 on Bottom Layer: 81.48,7.24 86.61,7.24 86.61,5.33 81.48,5.33

Small or netless copper shapes (teardrops, artwork), in the pictures only: 152 on Top Layer, 501 on Bottom Layer

## Text on the board
Bottom Silkscreen Layer: 3V3 | MSI | GND | SCK | DC | BSY | CS | RST | PWR | 5V
Top Silkscreen Layer: REMOTE-A V101 | SEMANTIC BOAT PROJECT
